# Altium schematic sheet Amps.SchDoc (part 1 of 2)
size 1651 x 330 mm; SheetNumber: 3; SheetTotal: 4
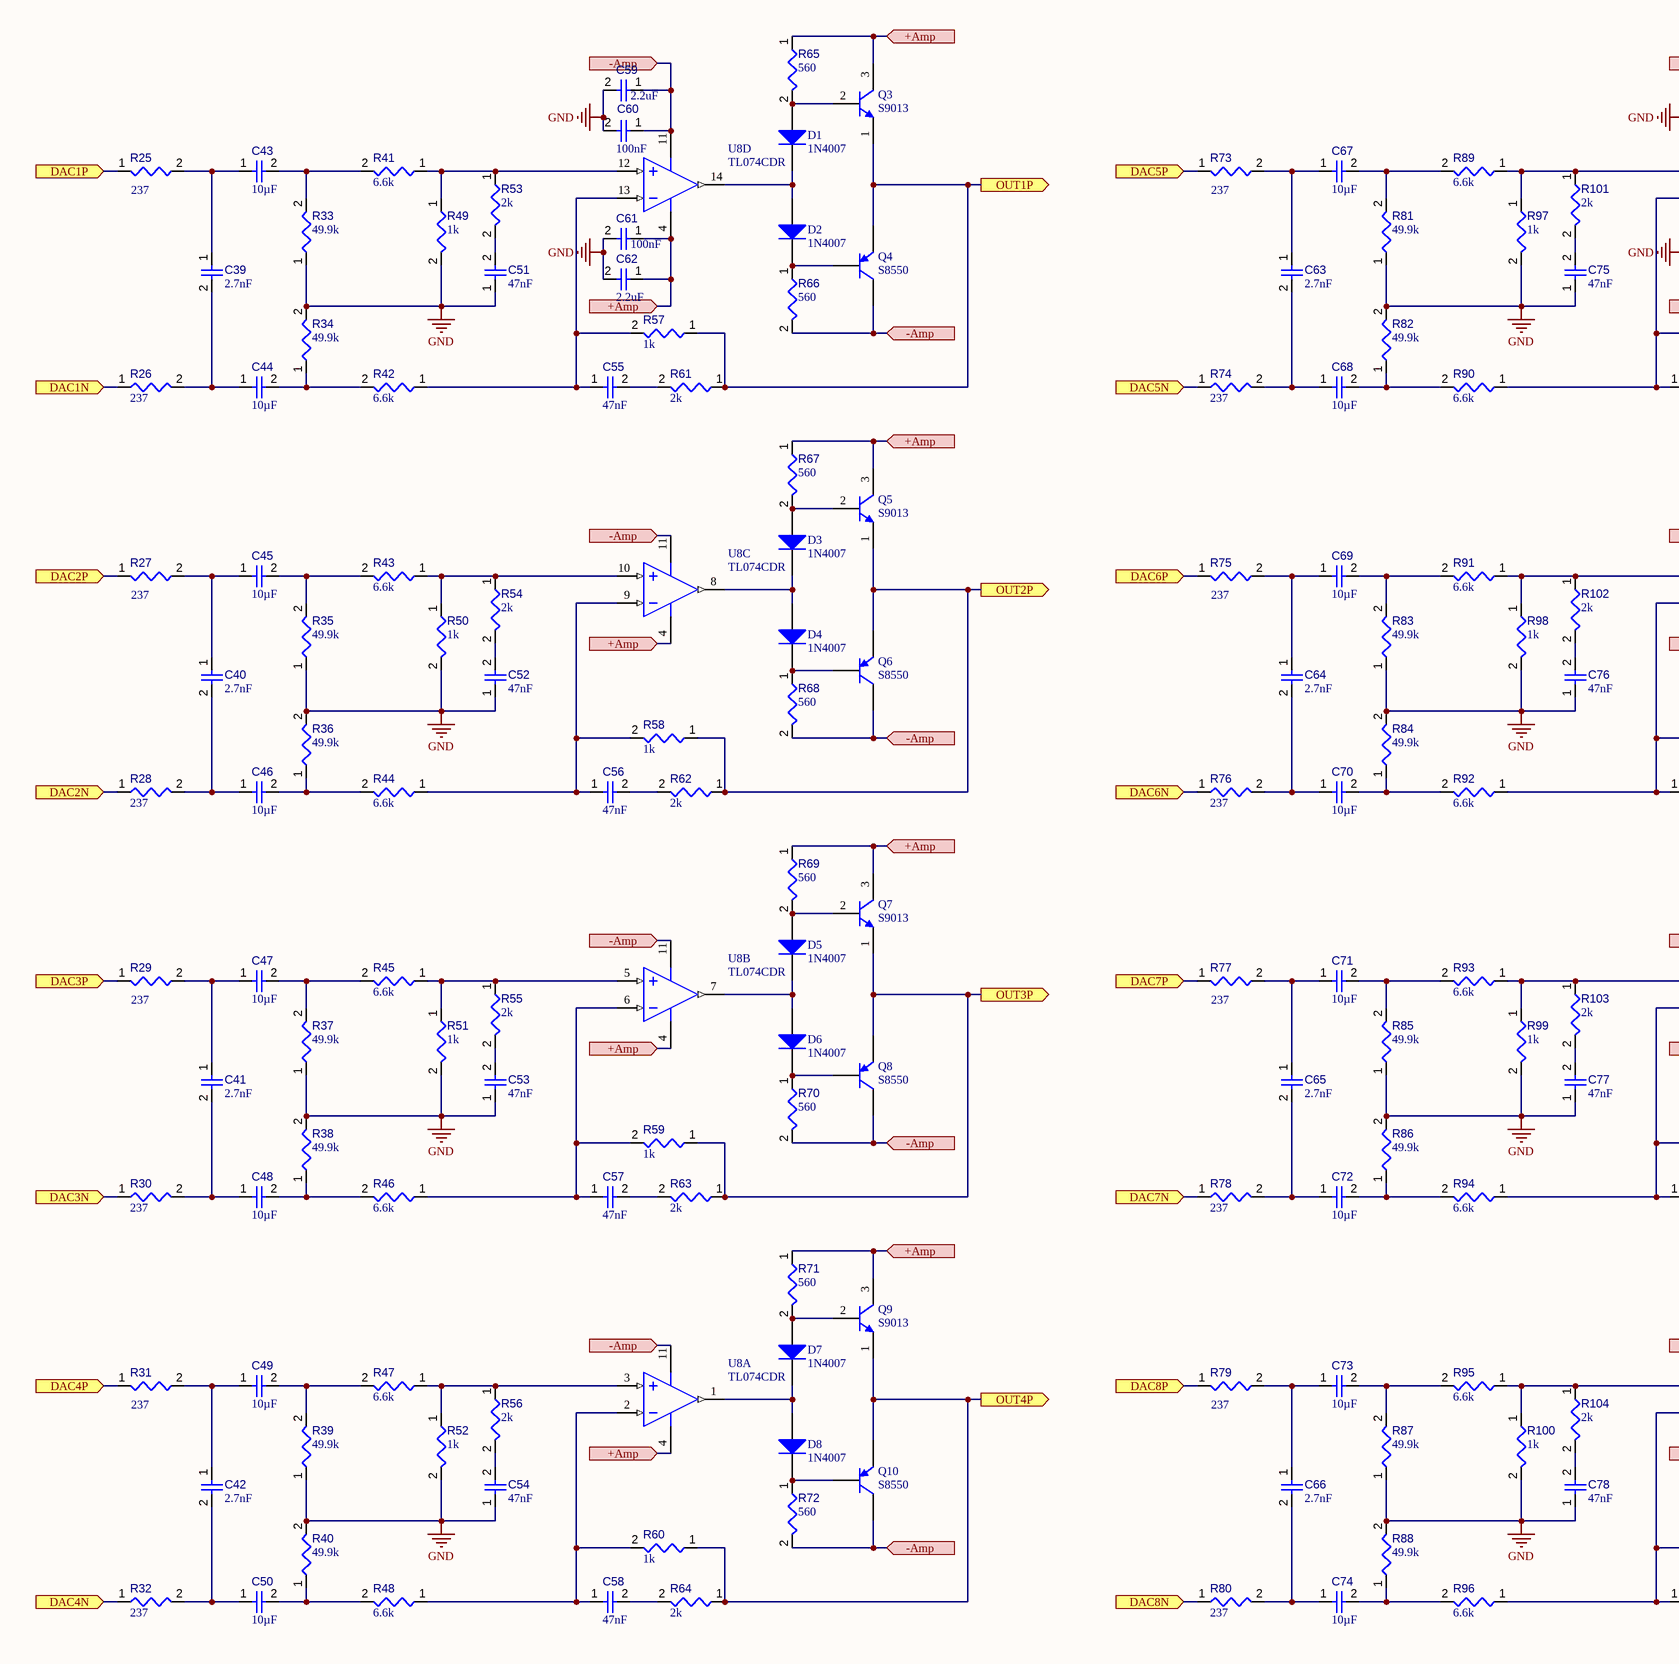
[diagram p0: Amps.SchDoc, column 1 of 5]
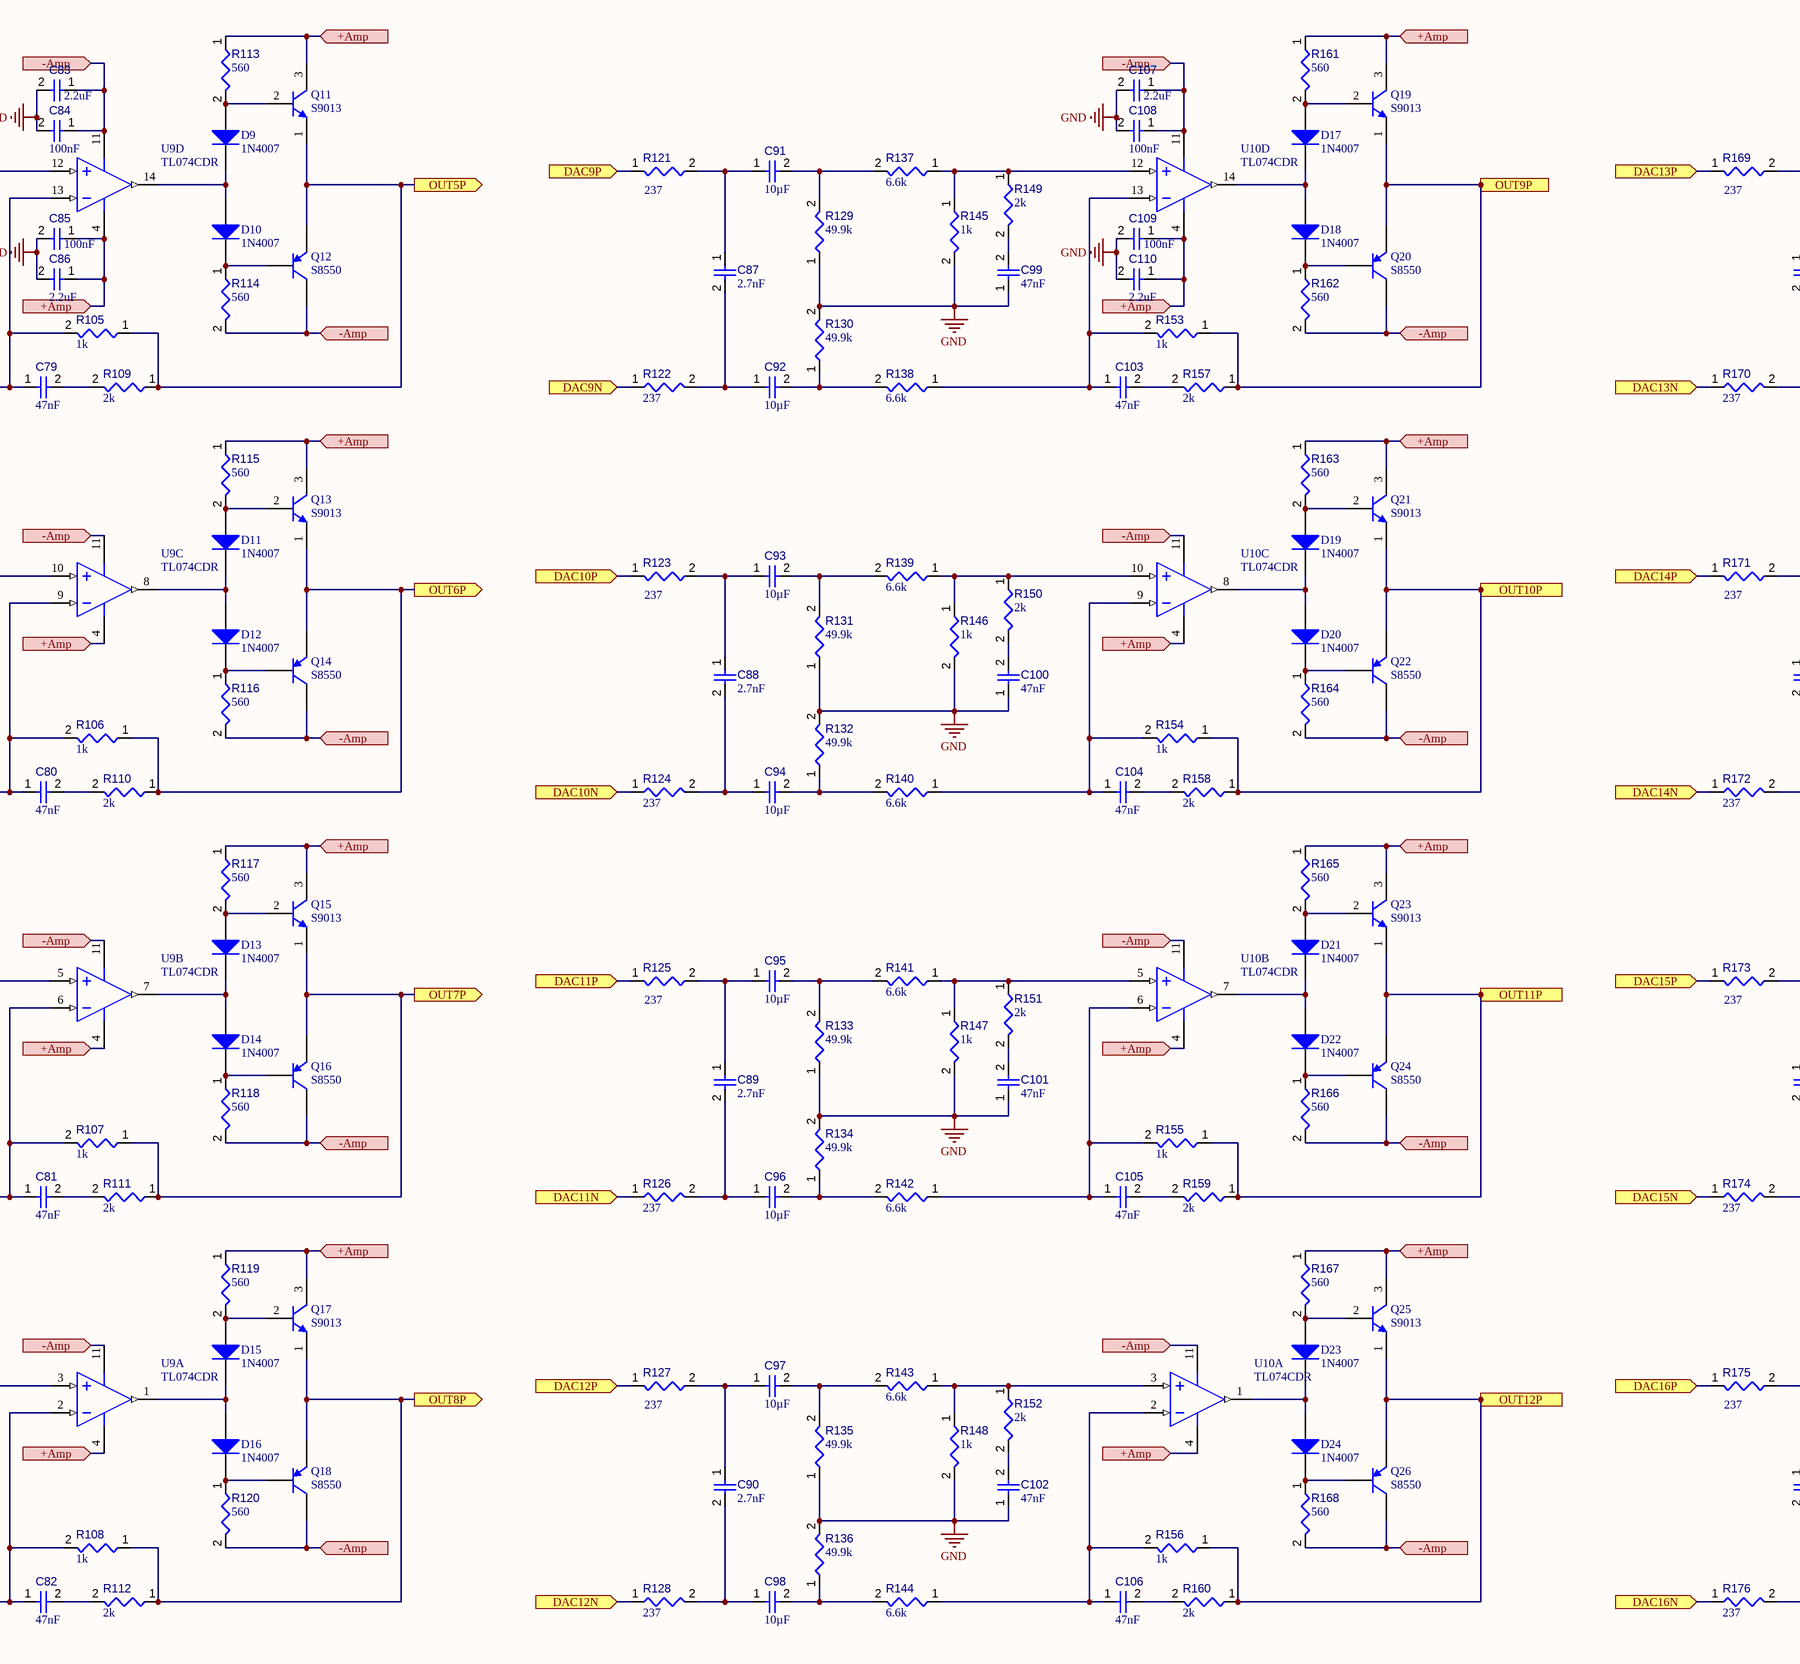
[diagram p1: Amps.SchDoc, column 2 of 5]
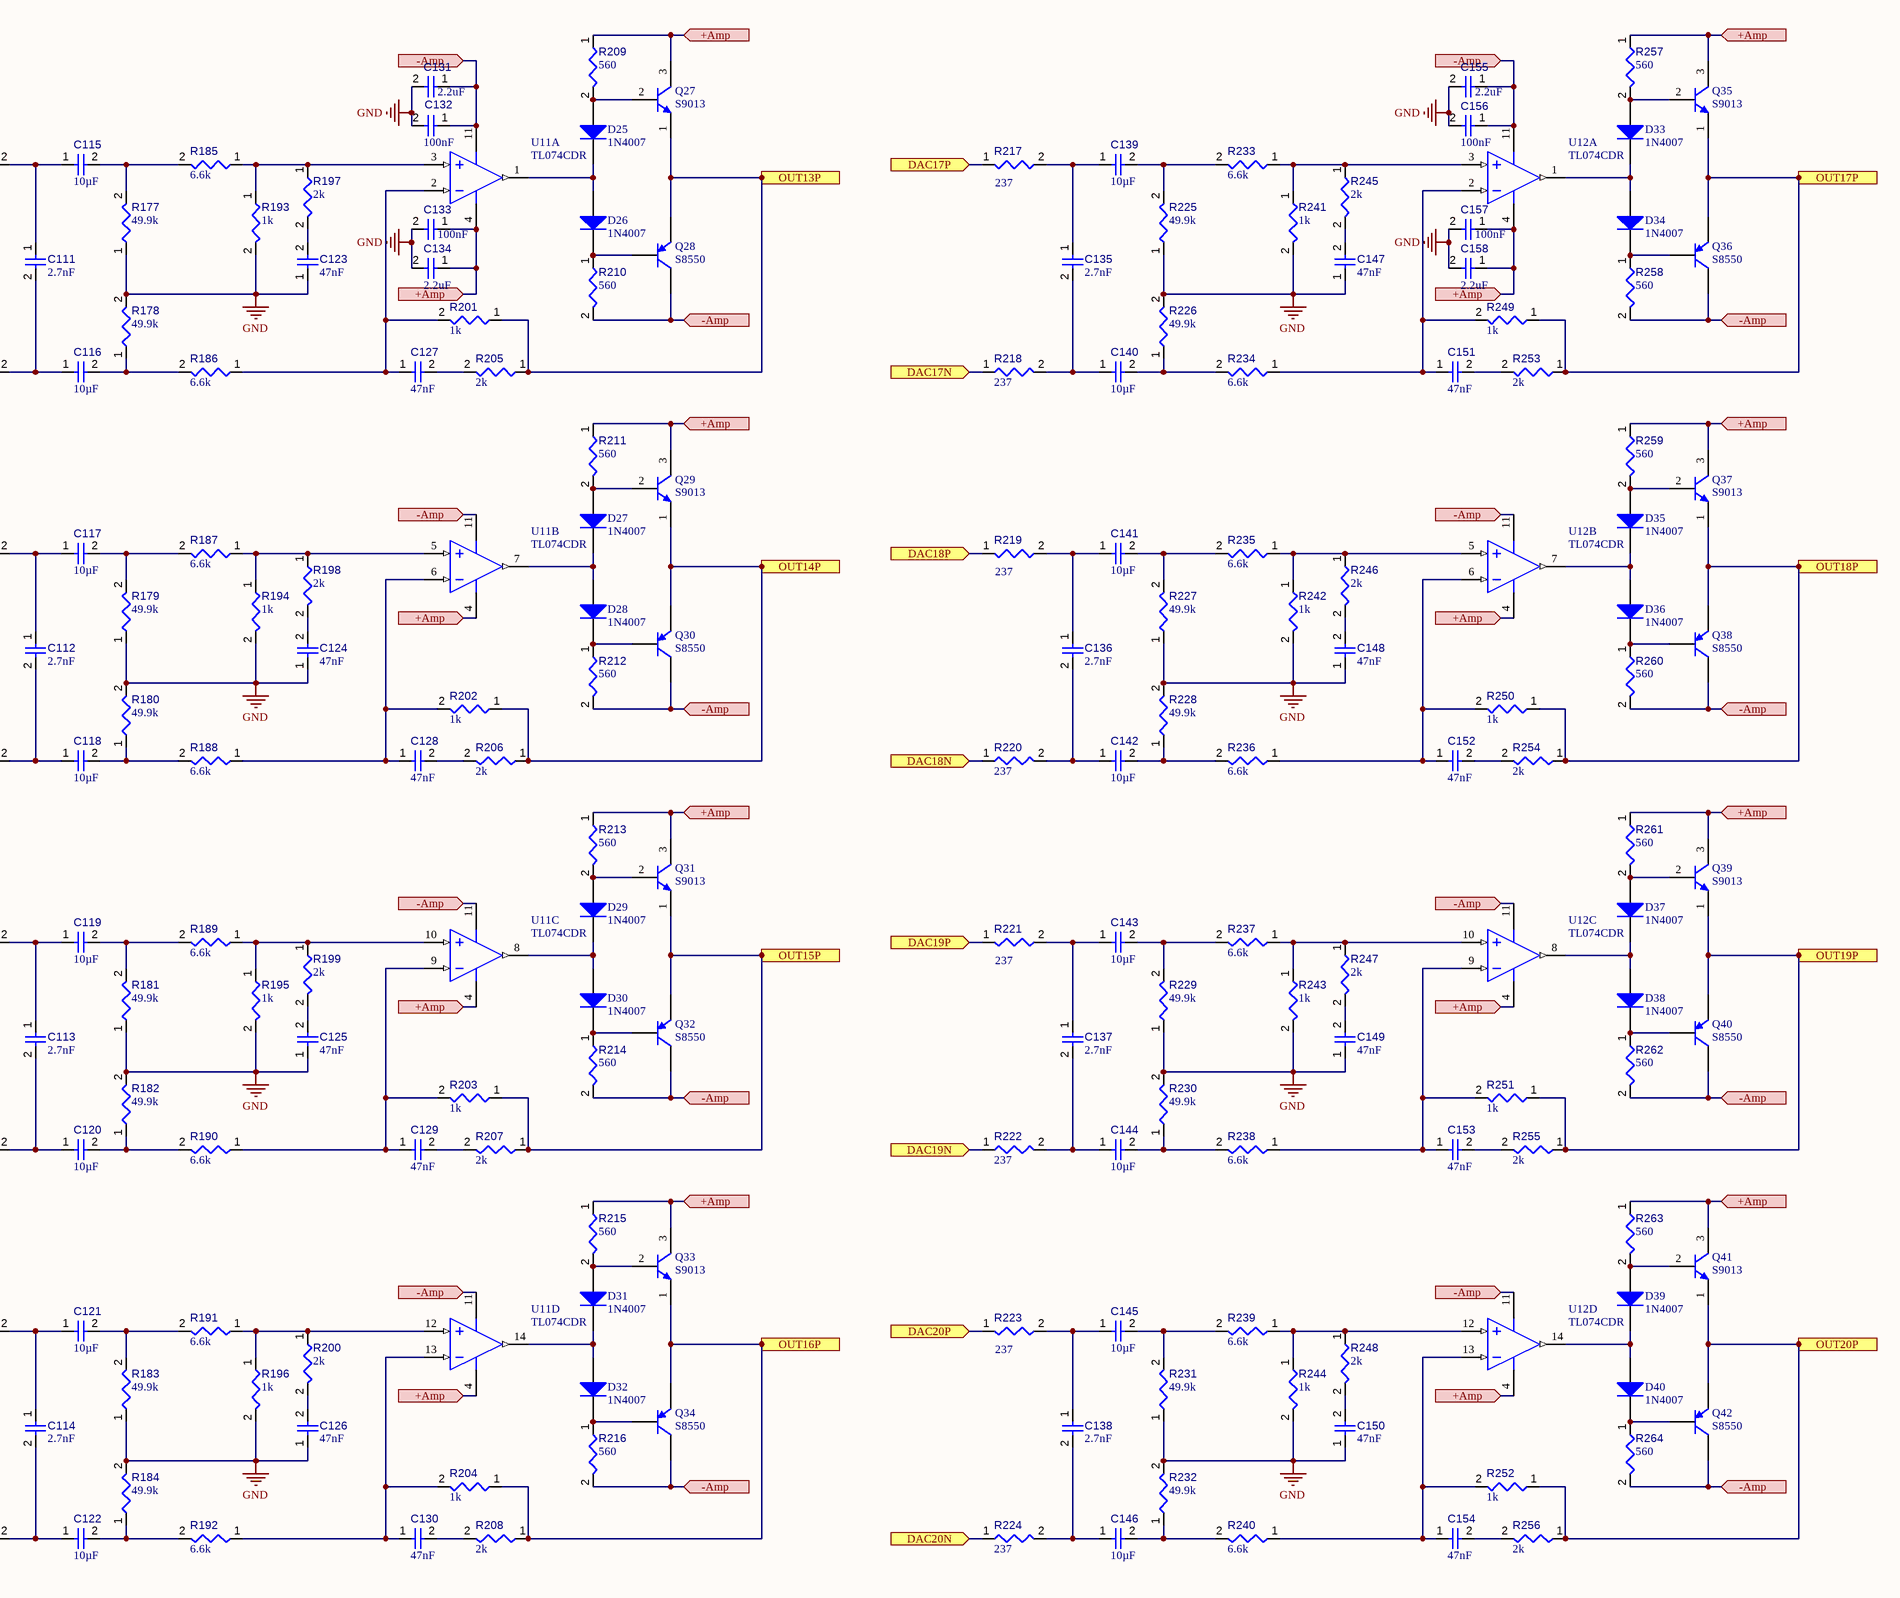
[diagram p2: Amps.SchDoc, column 3 of 5]
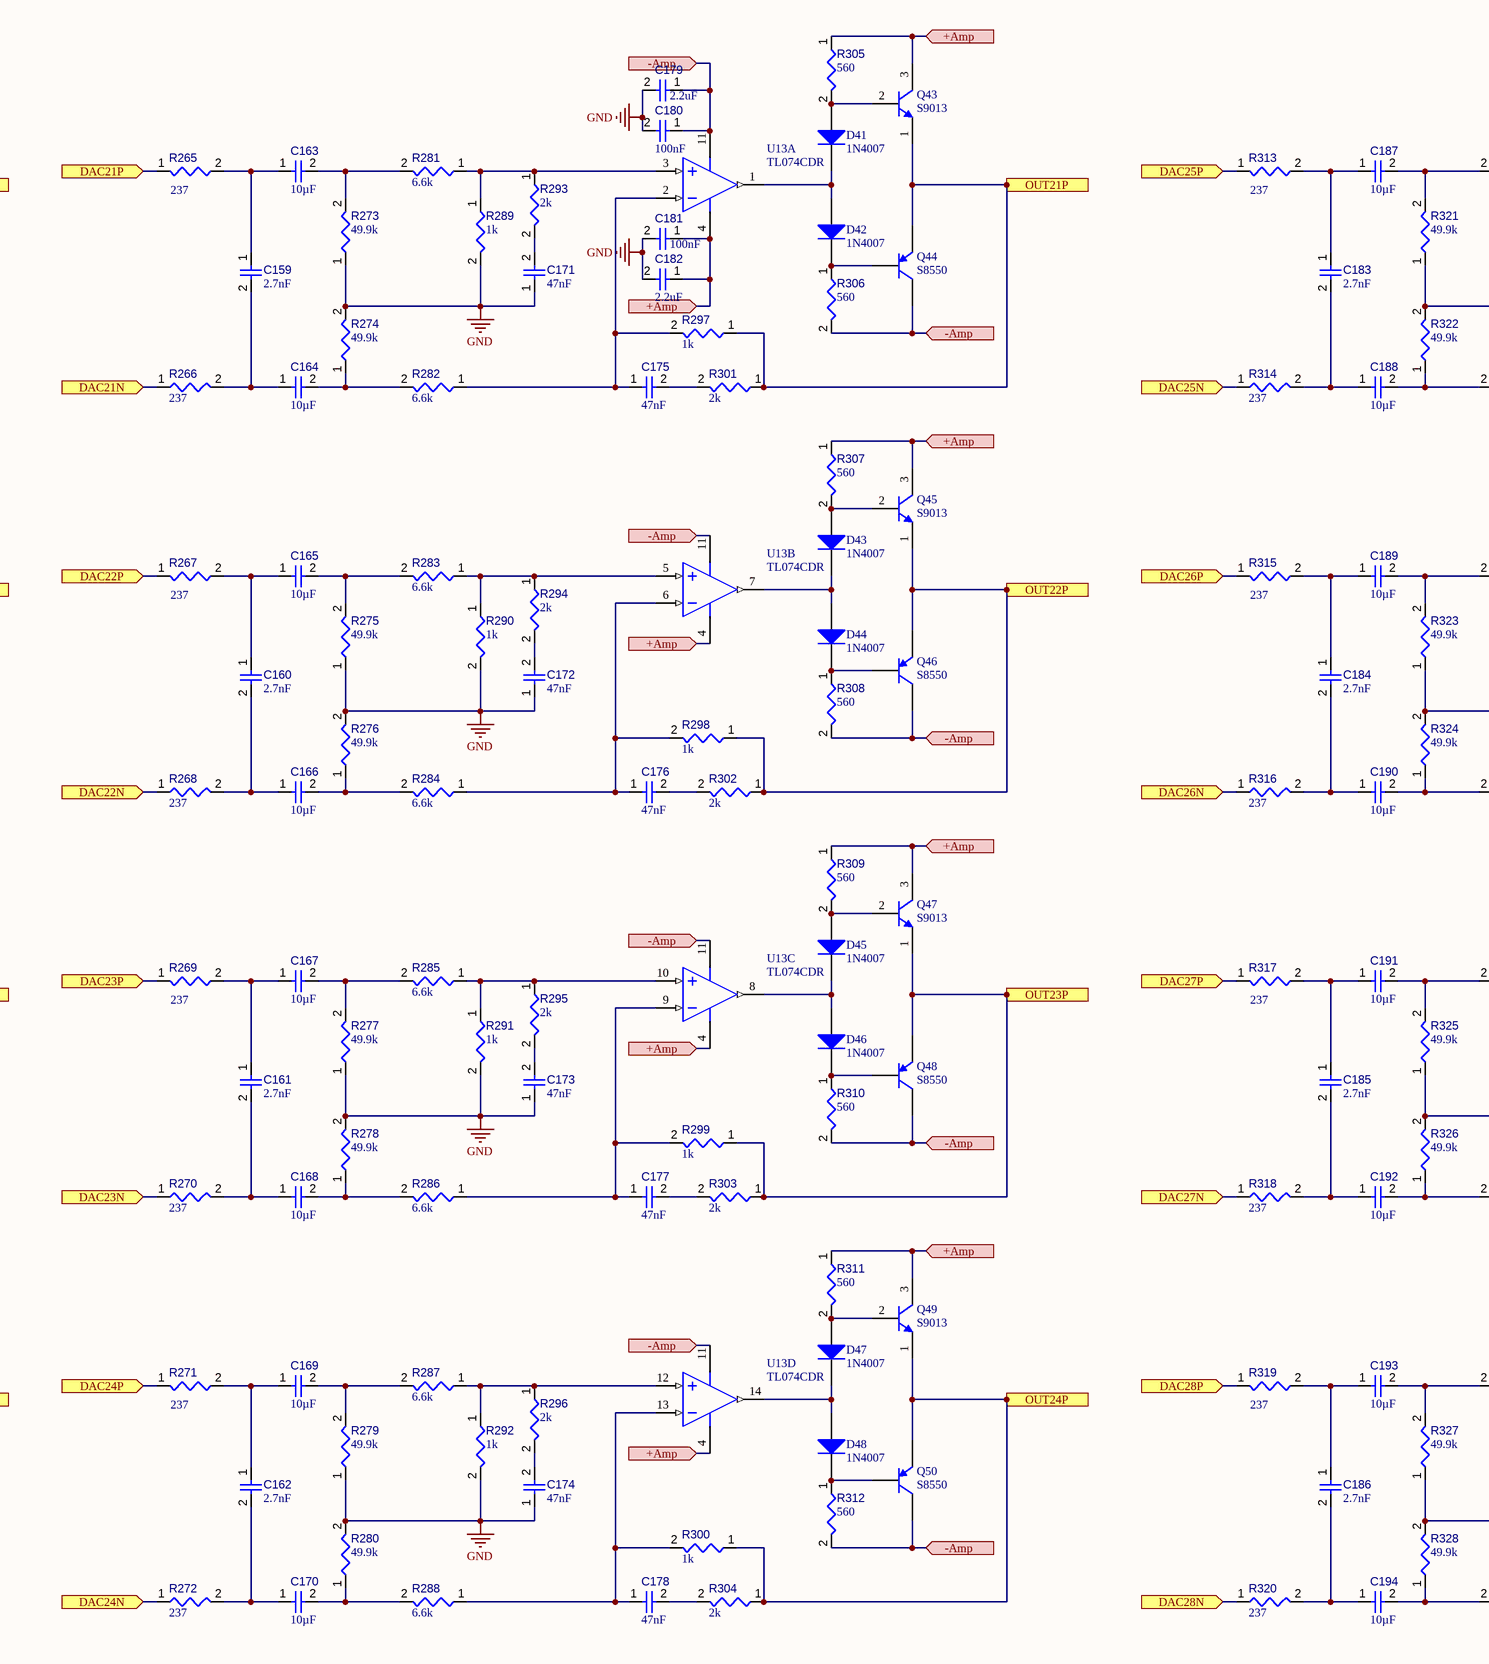
[diagram p3: Amps.SchDoc, column 4 of 5]
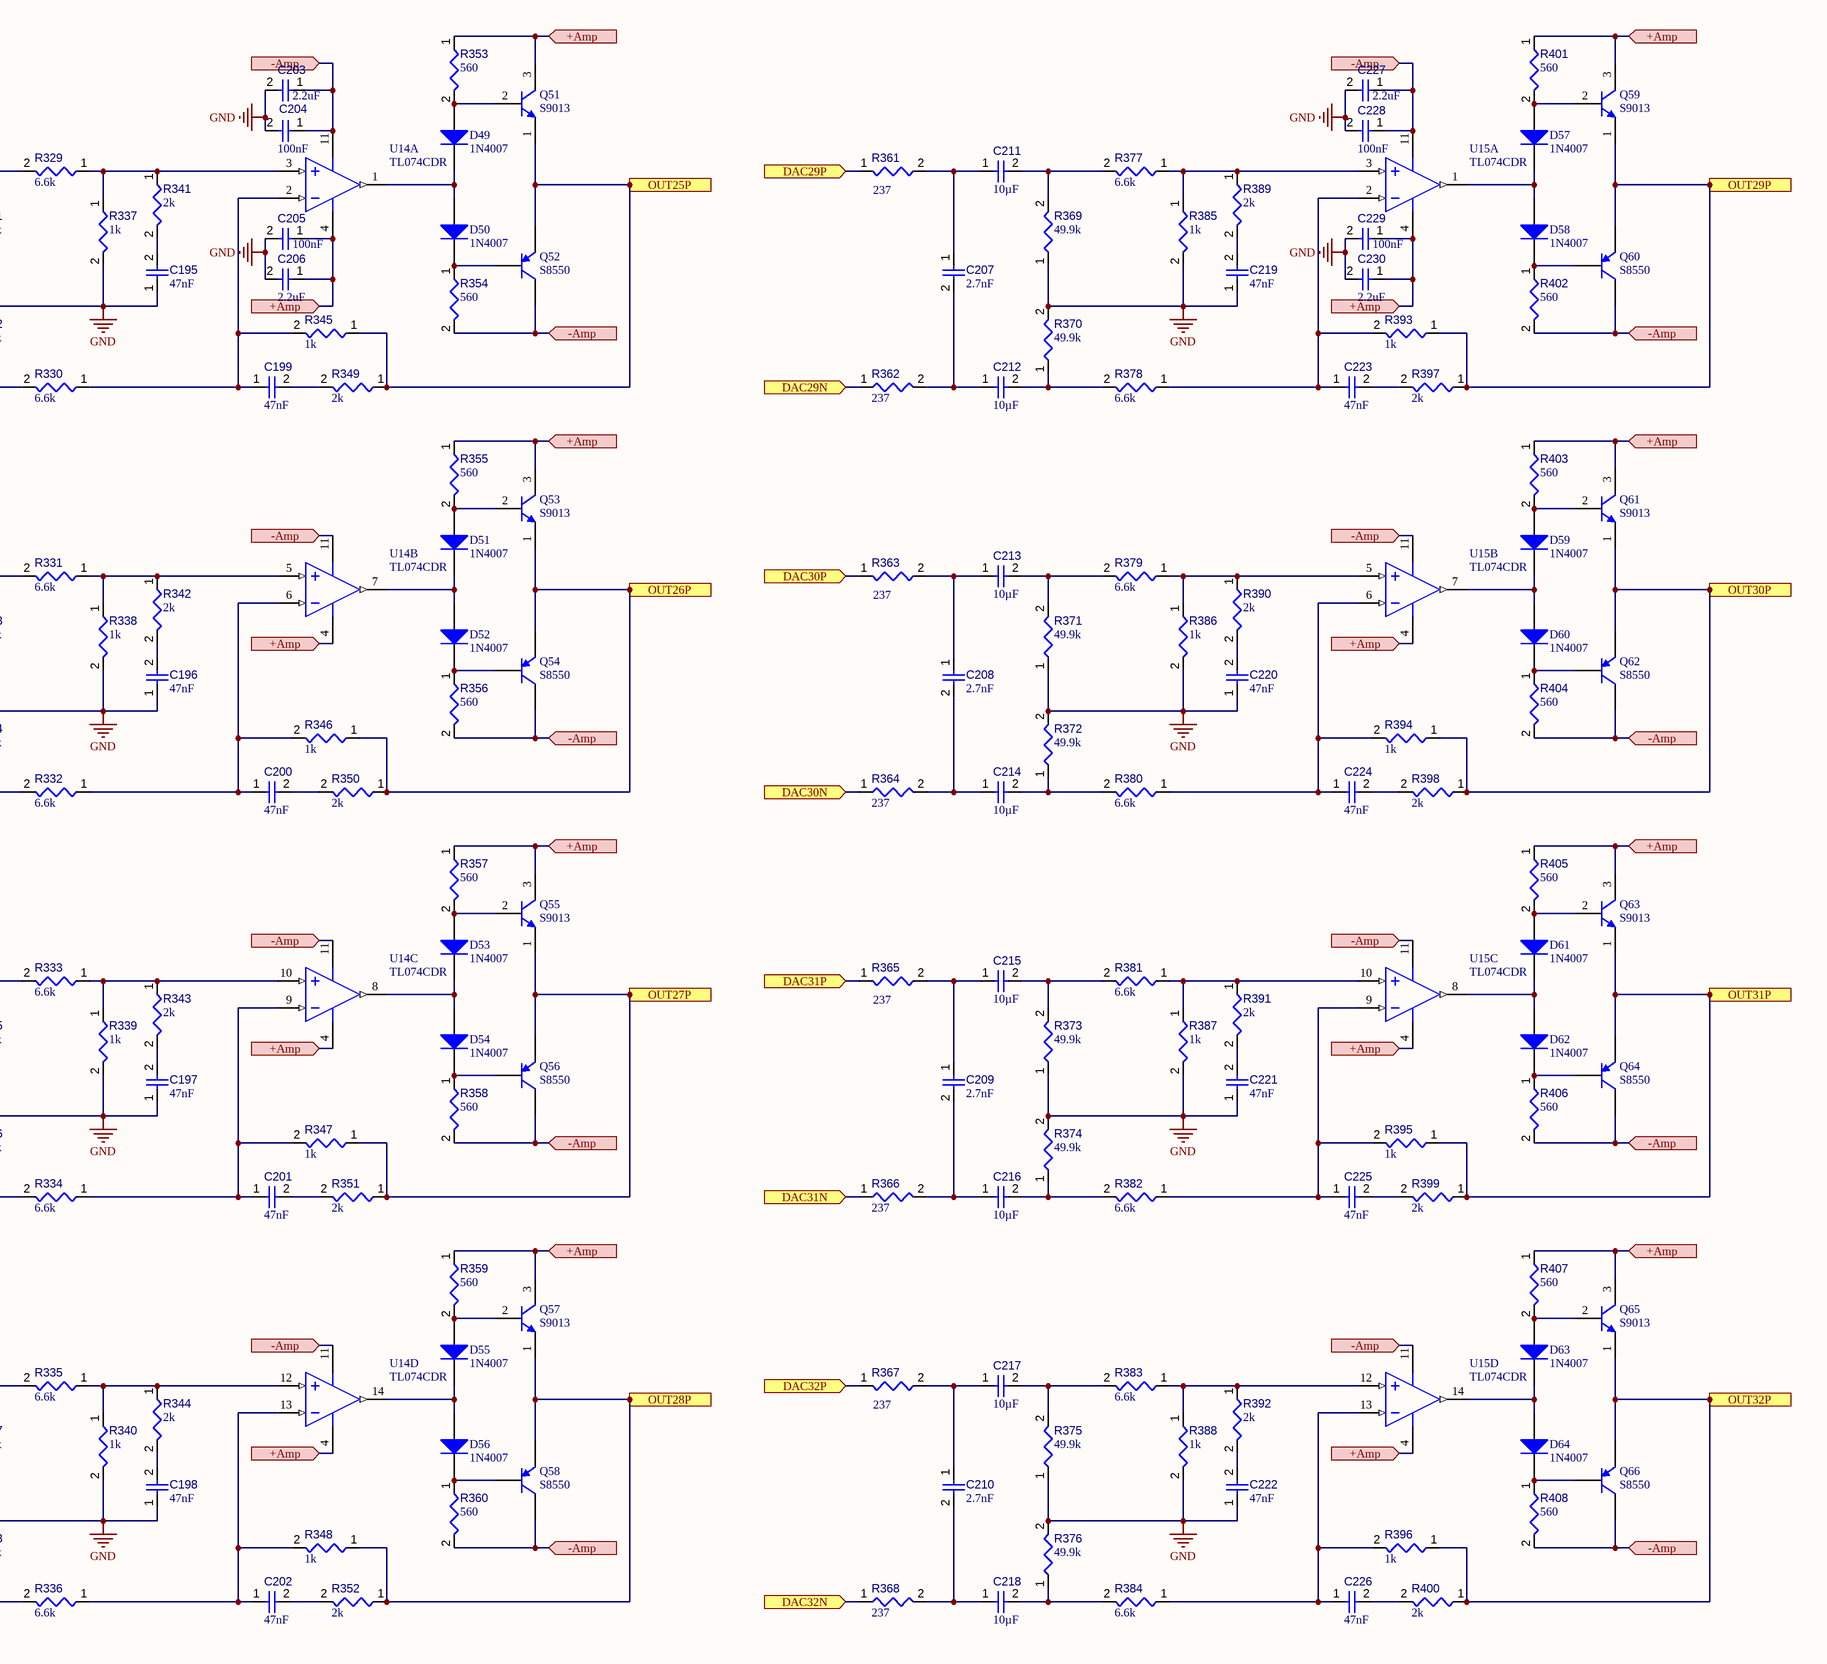
[diagram p4: Amps.SchDoc, column 5 of 5]

## Parts
C39  value 2.7nF  [CAPC0603(1608)100_L]  (hidden comment: Capacitor 2.7nF 0603)
C40  value 2.7nF  [CAPC0603(1608)100_L]  (hidden comment: Capacitor 2.7nF 0603)
C41  value 2.7nF  [CAPC0603(1608)100_L]  (hidden comment: Capacitor 2.7nF 0603)
C42  value 2.7nF  [CAPC0603(1608)100_L]  (hidden comment: Capacitor 2.7nF 0603)
C43  value 10µF  [CAPC0805(2012)145_L]  (hidden comment: Capacitor 10µF +/-20% 25V 0805)
C44  value 10µF  [CAPC0805(2012)145_L]  (hidden comment: Capacitor 10µF +/-20% 25V 0805)
C45  value 10µF  [CAPC0805(2012)145_L]  (hidden comment: Capacitor 10µF +/-20% 25V 0805)
C46  value 10µF  [CAPC0805(2012)145_L]  (hidden comment: Capacitor 10µF +/-20% 25V 0805)
C47  value 10µF  [CAPC0805(2012)145_L]  (hidden comment: Capacitor 10µF +/-20% 25V 0805)
C48  value 10µF  [CAPC0805(2012)145_L]  (hidden comment: Capacitor 10µF +/-20% 25V 0805)
C49  value 10µF  [CAPC0805(2012)145_L]  (hidden comment: Capacitor 10µF +/-20% 25V 0805)
C50  value 10µF  [CAPC0805(2012)145_L]  (hidden comment: Capacitor 10µF +/-20% 25V 0805)
C51  value 47nF  [CAPC0603(1608)100_L]  (hidden comment: Capacitor 47nF 0603)
C52  value 47nF  [CAPC0603(1608)100_L]  (hidden comment: Capacitor 47nF 0603)
C53  value 47nF  [CAPC0603(1608)100_L]  (hidden comment: Capacitor 47nF 0603)
C54  value 47nF  [CAPC0603(1608)100_L]  (hidden comment: Capacitor 47nF 0603)
C55  value 47nF  [CAPC0603(1608)100_L]  (hidden comment: Capacitor 47nF 0603)
C56  value 47nF  [CAPC0603(1608)100_L]  (hidden comment: Capacitor 47nF 0603)
C57  value 47nF  [CAPC0603(1608)100_L]  (hidden comment: Capacitor 47nF 0603)
C58  value 47nF  [CAPC0603(1608)100_L]  (hidden comment: Capacitor 47nF 0603)
C59  value 2.2uF  [CAPC0603(1608)100_L]  (hidden comment: Capacitor 2.2uF 0603)
C60  value 100nF  [CAPC0603(1608)100_L]  (hidden comment: Capacitor 100nF 0603)
C61  value 100nF  [CAPC0603(1608)100_L]  (hidden comment: Capacitor 100nF 0603)
C62  value 2.2uF  [CAPC0603(1608)100_L]  (hidden comment: Capacitor 2.2uF 0603)
C63  value 2.7nF  [CAPC0603(1608)100_L]  (hidden comment: Capacitor 2.7nF 0603)
C64  value 2.7nF  [CAPC0603(1608)100_L]  (hidden comment: Capacitor 2.7nF 0603)
C65  value 2.7nF  [CAPC0603(1608)100_L]  (hidden comment: Capacitor 2.7nF 0603)
C66  value 2.7nF  [CAPC0603(1608)100_L]  (hidden comment: Capacitor 2.7nF 0603)
C67  value 10µF  [CAPC0805(2012)145_L]  (hidden comment: Capacitor 10µF +/-20% 25V 0805)
C68  value 10µF  [CAPC0805(2012)145_L]  (hidden comment: Capacitor 10µF +/-20% 25V 0805)
C69  value 10µF  [CAPC0805(2012)145_L]  (hidden comment: Capacitor 10µF +/-20% 25V 0805)
C70  value 10µF  [CAPC0805(2012)145_L]  (hidden comment: Capacitor 10µF +/-20% 25V 0805)
C71  value 10µF  [CAPC0805(2012)145_L]  (hidden comment: Capacitor 10µF +/-20% 25V 0805)
C72  value 10µF  [CAPC0805(2012)145_L]  (hidden comment: Capacitor 10µF +/-20% 25V 0805)
C73  value 10µF  [CAPC0805(2012)145_L]  (hidden comment: Capacitor 10µF +/-20% 25V 0805)
C74  value 10µF  [CAPC0805(2012)145_L]  (hidden comment: Capacitor 10µF +/-20% 25V 0805)
C75  value 47nF  [CAPC0603(1608)100_L]  (hidden comment: Capacitor 47nF 0603)
C76  value 47nF  [CAPC0603(1608)100_L]  (hidden comment: Capacitor 47nF 0603)
C77  value 47nF  [CAPC0603(1608)100_L]  (hidden comment: Capacitor 47nF 0603)
C78  value 47nF  [CAPC0603(1608)100_L]  (hidden comment: Capacitor 47nF 0603)
C79  value 47nF  [CAPC0603(1608)100_L]  (hidden comment: Capacitor 47nF 0603)
C80  value 47nF  [CAPC0603(1608)100_L]  (hidden comment: Capacitor 47nF 0603)
C81  value 47nF  [CAPC0603(1608)100_L]  (hidden comment: Capacitor 47nF 0603)
C82  value 47nF  [CAPC0603(1608)100_L]  (hidden comment: Capacitor 47nF 0603)
C83  value 2.2uF  [CAPC0603(1608)100_L]  (hidden comment: Capacitor 2.2uF 0603)
C84  value 100nF  [CAPC0603(1608)100_L]  (hidden comment: Capacitor 100nF 0603)
C85  value 100nF  [CAPC0603(1608)100_L]  (hidden comment: Capacitor 100nF 0603)
C86  value 2.2uF  [CAPC0603(1608)100_L]  (hidden comment: Capacitor 2.2uF 0603)
C87  value 2.7nF  [CAPC0603(1608)100_L]  (hidden comment: Capacitor 2.7nF 0603)
C88  value 2.7nF  [CAPC0603(1608)100_L]  (hidden comment: Capacitor 2.7nF 0603)
C89  value 2.7nF  [CAPC0603(1608)100_L]  (hidden comment: Capacitor 2.7nF 0603)
C90  value 2.7nF  [CAPC0603(1608)100_L]  (hidden comment: Capacitor 2.7nF 0603)
C91  value 10µF  [CAPC0805(2012)145_L]  (hidden comment: Capacitor 10µF +/-20% 25V 0805)
C92  value 10µF  [CAPC0805(2012)145_L]  (hidden comment: Capacitor 10µF +/-20% 25V 0805)
C93  value 10µF  [CAPC0805(2012)145_L]  (hidden comment: Capacitor 10µF +/-20% 25V 0805)
C94  value 10µF  [CAPC0805(2012)145_L]  (hidden comment: Capacitor 10µF +/-20% 25V 0805)
C95  value 10µF  [CAPC0805(2012)145_L]  (hidden comment: Capacitor 10µF +/-20% 25V 0805)
C96  value 10µF  [CAPC0805(2012)145_L]  (hidden comment: Capacitor 10µF +/-20% 25V 0805)
C97  value 10µF  [CAPC0805(2012)145_L]  (hidden comment: Capacitor 10µF +/-20% 25V 0805)
C98  value 10µF  [CAPC0805(2012)145_L]  (hidden comment: Capacitor 10µF +/-20% 25V 0805)
C99  value 47nF  [CAPC0603(1608)100_L]  (hidden comment: Capacitor 47nF 0603)
C100  value 47nF  [CAPC0603(1608)100_L]  (hidden comment: Capacitor 47nF 0603)
C101  value 47nF  [CAPC0603(1608)100_L]  (hidden comment: Capacitor 47nF 0603)
C102  value 47nF  [CAPC0603(1608)100_L]  (hidden comment: Capacitor 47nF 0603)
C103  value 47nF  [CAPC0603(1608)100_L]  (hidden comment: Capacitor 47nF 0603)
C104  value 47nF  [CAPC0603(1608)100_L]  (hidden comment: Capacitor 47nF 0603)
C105  value 47nF  [CAPC0603(1608)100_L]  (hidden comment: Capacitor 47nF 0603)
C106  value 47nF  [CAPC0603(1608)100_L]  (hidden comment: Capacitor 47nF 0603)
C107  value 2.2uF  [CAPC0603(1608)100_L]  (hidden comment: Capacitor 2.2uF 0603)
C108  value 100nF  [CAPC0603(1608)100_L]  (hidden comment: Capacitor 100nF 0603)
C109  value 100nF  [CAPC0603(1608)100_L]  (hidden comment: Capacitor 100nF 0603)
C110  value 2.2uF  [CAPC0603(1608)100_L]  (hidden comment: Capacitor 2.2uF 0603)
C111  value 2.7nF  [CAPC0603(1608)100_L]  (hidden comment: Capacitor 2.7nF 0603)
C112  value 2.7nF  [CAPC0603(1608)100_L]  (hidden comment: Capacitor 2.7nF 0603)
C113  value 2.7nF  [CAPC0603(1608)100_L]  (hidden comment: Capacitor 2.7nF 0603)
C114  value 2.7nF  [CAPC0603(1608)100_L]  (hidden comment: Capacitor 2.7nF 0603)
C115  value 10µF  [CAPC0805(2012)145_L]  (hidden comment: Capacitor 10µF +/-20% 25V 0805)
C116  value 10µF  [CAPC0805(2012)145_L]  (hidden comment: Capacitor 10µF +/-20% 25V 0805)
C117  value 10µF  [CAPC0805(2012)145_L]  (hidden comment: Capacitor 10µF +/-20% 25V 0805)
C118  value 10µF  [CAPC0805(2012)145_L]  (hidden comment: Capacitor 10µF +/-20% 25V 0805)
C119  value 10µF  [CAPC0805(2012)145_L]  (hidden comment: Capacitor 10µF +/-20% 25V 0805)
C120  value 10µF  [CAPC0805(2012)145_L]  (hidden comment: Capacitor 10µF +/-20% 25V 0805)
C121  value 10µF  [CAPC0805(2012)145_L]  (hidden comment: Capacitor 10µF +/-20% 25V 0805)
C122  value 10µF  [CAPC0805(2012)145_L]  (hidden comment: Capacitor 10µF +/-20% 25V 0805)
C123  value 47nF  [CAPC0603(1608)100_L]  (hidden comment: Capacitor 47nF 0603)
C124  value 47nF  [CAPC0603(1608)100_L]  (hidden comment: Capacitor 47nF 0603)
C125  value 47nF  [CAPC0603(1608)100_L]  (hidden comment: Capacitor 47nF 0603)
C126  value 47nF  [CAPC0603(1608)100_L]  (hidden comment: Capacitor 47nF 0603)
C127  value 47nF  [CAPC0603(1608)100_L]  (hidden comment: Capacitor 47nF 0603)
C128  value 47nF  [CAPC0603(1608)100_L]  (hidden comment: Capacitor 47nF 0603)
C129  value 47nF  [CAPC0603(1608)100_L]  (hidden comment: Capacitor 47nF 0603)
C130  value 47nF  [CAPC0603(1608)100_L]  (hidden comment: Capacitor 47nF 0603)
C131  value 2.2uF  [CAPC0603(1608)100_L]  (hidden comment: Capacitor 2.2uF 0603)